# Altium schematic sheet klpflyv1.0.SchDoc: klpfly (continued)
## Library data of the parts (continued)
C22 = 100nF: Convert to PCB: yes; UniqueId: gged673bfa93339740f; OriginModelName: C0603_L1.6-W0.8-H0.8; ModelTransform: 62.992,31.496,0,0,0,0,0,0,0; Device: 100nF; Add into BOM: yes; SymbolName: 100nF; FootprintName: C0603
C23 = 100nF: Convert to PCB: yes; UniqueId: gge03e79812ca9f1594; OriginModelName: C0603_L1.6-W0.8-H0.8; ModelTransform: 62.992,31.496,0,0,0,0,0,0,0; Device: 100nF; Add into BOM: yes; SymbolName: 100nF; FootprintName: C0603
C24 = 2.2uF: Convert to PCB: yes; UniqueId: gge194ad5a5974422c7; OriginModelName: C0603_L1.6-W0.8-H0.8; ModelTransform: 62.992,31.496,0,0,0,0,0,0,0; Device: 2.2uF; Add into BOM: yes; SymbolName: 2.2uF; FootprintName: C0603
C25 = 100nF: Convert to PCB: yes; UniqueId: ggec38fa6919078953f; OriginModelName: C0603_L1.6-W0.8-H0.8; ModelTransform: 62.992,31.496,0,0,0,0,0,0,0; Device: 100nF; Add into BOM: yes; SymbolName: 100nF; FootprintName: C0603
C26 = 10uF: Convert to PCB: yes; UniqueId: ggeeb9301ced7e232ca; OriginModelName: C0603_L1.6-W0.8-H0.8; ModelTransform: 62.992,31.496,0,0,0,0,0,0,0; Device: 10uF; Add into BOM: yes; SymbolName: 10uF; FootprintName: C0603
C27 = 10uF: Convert to PCB: yes; UniqueId: gge9a113f5a677df9d8; OriginModelName: C0603_L1.6-W0.8-H0.8; ModelTransform: 62.992,31.496,0,0,0,0,0,0,0; Device: 10uF; Add into BOM: yes; SymbolName: 10uF; FootprintName: C0603
C28 = 100nF: Convert to PCB: yes; UniqueId: ggef40206292685441e; OriginModelName: C0603_L1.6-W0.8-H0.8; ModelTransform: 62.992,31.496,0,0,0,0,0,0,0; Device: 100nF; Add into BOM: yes; SymbolName: 100nF; FootprintName: C0603
C29 = 100nF: Convert to PCB: yes; UniqueId: gge2ebcfc57574d399a; OriginModelName: C0603_L1.6-W0.8-H0.8; ModelTransform: 62.992,31.496,0,0,0,0,0,0,0; Device: 100nF; Add into BOM: yes; SymbolName: 100nF; FootprintName: C0603
C30 = 100nF: Convert to PCB: yes; UniqueId: gged33014bcecda883b; OriginModelName: C0603_L1.6-W0.8-H0.8; ModelTransform: 62.992,31.496,0,0,0,0,0,0,0; Device: 100nF; Add into BOM: yes; SymbolName: 100nF; FootprintName: C0603
C31 = 100nF: Convert to PCB: yes; UniqueId: ggee2bd2f168eb7a19f; OriginModelName: C0603_L1.6-W0.8-H0.8; ModelTransform: 62.992,31.496,0,0,0,0,0,0,0; Device: 100nF; Add into BOM: yes; SymbolName: 100nF; FootprintName: C0603
C32 = 100nF: Convert to PCB: yes; UniqueId: ggedee51cfaf3930afd; OriginModelName: C0603_L1.6-W0.8-H0.8; ModelTransform: 62.992,31.496,0,0,0,0,0,0,0; Device: 100nF; Add into BOM: yes; SymbolName: 100nF; FootprintName: C0603
C33 = 100nF: Convert to PCB: yes; UniqueId: gge26811f5395af21ce; OriginModelName: C0603_L1.6-W0.8-H0.8; ModelTransform: 62.992,31.496,0,0,0,0,0,0,0; Device: 100nF; Add into BOM: yes; SymbolName: 100nF; FootprintName: C0603
C34 = 100nF: Convert to PCB: yes; UniqueId: gge8daa5e5140b19545; OriginModelName: C0603_L1.6-W0.8-H0.8; ModelTransform: 62.992,31.496,0,0,0,0,0,0,0; Device: 100nF; Add into BOM: yes; SymbolName: 100nF; FootprintName: C0603
C35 = 100nF: Convert to PCB: yes; UniqueId: gge108316898df37a9f; OriginModelName: C0603_L1.6-W0.8-H0.8; ModelTransform: 62.992,31.496,0,0,0,0,0,0,0; Device: 100nF; Add into BOM: yes; SymbolName: 100nF; FootprintName: C0603
C36 = 100nF: Convert to PCB: yes; UniqueId: gge1844c11426338be2; OriginModelName: C0603_L1.6-W0.8-H0.8; ModelTransform: 62.992,31.496,0,0,0,0,0,0,0; Device: 100nF; Add into BOM: yes; SymbolName: 100nF; FootprintName: C0603
C37 = 100nF: Convert to PCB: yes; UniqueId: ggefc1b89ea0528c883; OriginModelName: C0603_L1.6-W0.8-H0.8; ModelTransform: 62.992,31.496,0,0,0,0,0,0,0; Device: 100nF; Add into BOM: yes; SymbolName: 100nF; FootprintName: C0603
C38 = 100nF: Convert to PCB: yes; UniqueId: gge2b0adef4c2000f72; OriginModelName: C0603_L1.6-W0.8-H0.8; ModelTransform: 62.992,31.496,0,0,0,0,0,0,0; Device: 100nF; Add into BOM: yes; SymbolName: 100nF; FootprintName: C0603
C39 = 2.2uF: Convert to PCB: yes; UniqueId: gge6b0287d4c016d85a; OriginModelName: C0603_L1.6-W0.8-H0.8; ModelTransform: 62.992,31.496,0,0,0,0,0,0,0; Device: 2.2uF; Add into BOM: yes; SymbolName: 2.2uF; FootprintName: C0603
CN1 = ZX-SH1.0-6PWT: Manufacturer: Megastar(兆星); Convert to PCB: yes; UniqueId: ggecd9d3fcf4734ba22; ModelTransform: 329.1332,198.8185,0,0,0,0,0.002,-7.876,0; Device: ZX-SH1.0-6PWT; Supplier: LCSC; Supplier Part: C7430448; Manufacturer Part: ZX-SH1.0-6PWT; JLCPCB Part Class: Extended Part; link: https://so.szlcsc.com/global.html?k=C7430448&ref=editor; Add into BOM: yes; SymbolName: SH1.0X6P; FootprintName: CONN-SMD_6P-P1.00_MEGASTAR_ZX-SH1.0-6PWT; OriginModelName: CONN-SMD_6P-P1.00_MEGASTAR_ZX-SH1.0-6PWT
CN2 = HDGC1002WR-S-3P: Manufacturer: HDGC(华德共创); Convert to PCB: yes; UniqueId: gge2ce44b7eaad9832b; ModelTransform: 210.63,196.85,0,0,0,0,0,-9.565,0; Device: HDGC1002WR-S-3P; Supplier: LCSC; Supplier Part: C2936213; Manufacturer Part: HDGC1002WR-S-3P; JLCPCB Part Class: Extended Part; Add into BOM: yes; SymbolName: SH1.0-3P; FootprintName: CONN-SMD_3P-P1.00_HDGC_HDGC1002WR-S-3P; OriginModelName: CONN-SMD_3P-P1.00_HDGC_HDGC1002WR-S-3P
CN3 = WAFER_SMT_1.0X8: Manufacturer: null; Convert to PCB: yes; UniqueId: ggebe725300a9fc9f2b; ModelTransform: 407.873,198.8185,0,0,0,0,-0.001,-16.732,0; Device: WAFER_SMT_1.0X8; Supplier: LCSC; Supplier Part: C9900021939; Manufacturer Part: WAFER_SMT_1.0X8; JLCPCB Part Class: Extended Part; Add into BOM: yes; SymbolName: SH1.0X8P; FootprintName: CONN-SMD_8P-P1.00_WAFER-SH1.0-8PWB; OriginModelName: CONN-SMD_8P-P1.00_WAFER-SH1.0-8PWB
CN4 = HDGC1002WR-S-3P: Manufacturer: HDGC(华德共创); Convert to PCB: yes; UniqueId: ggec0020a35e89ad4ff; ModelTransform: 210.63,196.85,0,0,0,0,0,-9.565,0; Device: HDGC1002WR-S-3P; Supplier: LCSC; Supplier Part: C2936213; Manufacturer Part: HDGC1002WR-S-3P; JLCPCB Part Class: Extended Part; Add into BOM: yes; SymbolName: SH1.0-3P; FootprintName: CONN-SMD_3P-P1.00_HDGC_HDGC1002WR-S-3P; OriginModelName: CONN-SMD_3P-P1.00_HDGC_HDGC1002WR-S-3P
CN5 = HDGC1002WR-S-3P: Manufacturer: HDGC(华德共创); Convert to PCB: yes; UniqueId: gge5e0003f38aa131f5; ModelTransform: 210.63,196.85,0,0,0,0,0,-9.565,0; Device: HDGC1002WR-S-3P; Supplier: LCSC; Supplier Part: C2936213; Manufacturer Part: HDGC1002WR-S-3P; JLCPCB Part Class: Extended Part; Add into BOM: yes; SymbolName: SH1.0-3P; FootprintName: CONN-SMD_3P-P1.00_HDGC_HDGC1002WR-S-3P; OriginModelName: CONN-SMD_3P-P1.00_HDGC_HDGC1002WR-S-3P
CN6 = HDGC1002WR-S-3P: Manufacturer: HDGC(华德共创); Convert to PCB: yes; UniqueId: ggecca6adc977efc5d6; ModelTransform: 210.63,196.85,0,0,0,0,0,-9.565,0; Device: HDGC1002WR-S-3P; Supplier: LCSC; Supplier Part: C2936213; Manufacturer Part: HDGC1002WR-S-3P; JLCPCB Part Class: Extended Part; Add into BOM: yes; SymbolName: SH1.0-3P; FootprintName: CONN-SMD_3P-P1.00_HDGC_HDGC1002WR-S-3P; OriginModelName: CONN-SMD_3P-P1.00_HDGC_HDGC1002WR-S-3P
CN7 = ZX-SH1.0-6PWT: Manufacturer: Megastar(兆星); Convert to PCB: yes; UniqueId: gge7f46dd2bd5c42fec; ModelTransform: 329.1332,198.8185,0,0,0,0,0.002,-7.876,0; Device: ZX-SH1.0-6PWT; Supplier: LCSC; Supplier Part: C7430448; Manufacturer Part: ZX-SH1.0-6PWT; JLCPCB Part Class: Extended Part; link: https://so.szlcsc.com/global.html?k=C7430448&ref=editor; Add into BOM: yes; SymbolName: SH1.0X6P; FootprintName: CONN-SMD_6P-P1.00_MEGASTAR_ZX-SH1.0-6PWT; OriginModelName: CONN-SMD_6P-P1.00_MEGASTAR_ZX-SH1.0-6PWT
CN8 = HDGC1002WR-S-4P: Manufacturer: HDGC(华德共创); Convert to PCB: yes; UniqueId: ggee5a51ee7bd50bb1d; ModelTransform: 249.9995,196.85,0,0,0,0,0,-5.906,0; Device: HDGC1002WR-S-4P; Supplier: LCSC; Supplier Part: C2936214; Manufacturer Part: HDGC1002WR-S-4P; JLCPCB Part Class: Extended Part; Add into BOM: yes; SymbolName: HDGC1002WR-S-4P; FootprintName: CONN-SMD_4P-P1.00_HDGC_HDGC1002WR-S-4P; OriginModelName: CONN-SMD_4P-P1.00_HDGC_HDGC1002WR-S-4P
D1 = B5817WS-MS: Manufacturer: MSKSEMI(美森科); Convert to PCB: yes; UniqueId: gge7bf08ecfc7523faa; ModelTransform: 104.3305,51.181,0,0,0,0,0,0,0; Device: B5817WS-MS; Supplier: LCSC; Supplier Part: C2836388; Manufacturer Part: B5817WS-MS; JLCPCB Part Class: Extended Part; Add into BOM: yes; SymbolName: B5817WS-MS; FootprintName: SOD-323_L1.7-W1.3-LS2.7-FD; OriginModelName: SOD-323_L1.7-W1.3-LS2.7-FD
D2 = B5817WS-MS: Manufacturer: MSKSEMI(美森科); Convert to PCB: yes; UniqueId: gge33ebbc6fa40b7b0c; ModelTransform: 104.3305,51.181,0,0,0,0,0,0,0; Device: B5817WS-MS; Supplier: LCSC; Supplier Part: C2836388; Manufacturer Part: B5817WS-MS; JLCPCB Part Class: Extended Part; Add into BOM: yes; SymbolName: B5817WS-MS; FootprintName: SOD-323_L1.7-W1.3-LS2.7-FD; OriginModelName: SOD-323_L1.7-W1.3-LS2.7-FD
D3 = SMF28CA: Manufacturer: AnBon(安邦); Convert to PCB: yes; UniqueId: gge8336ca0810bb463b; ModelTransform: 145.669,70.866,0,0,0,0,0,0,0; Device: SMF28CA; Supplier: LCSC; Supplier Part: C435496; Manufacturer Part: SMF28CA; JLCPCB Part Class: Extended Part; link: https://so.szlcsc.com/global.html?k=C435496&ref=editor; Add into BOM: yes; SymbolName: SMF28CA; FootprintName: SOD-123_L2.7-W1.8-LS3.7-BI; OriginModelName: SOD-123_L2.7-W1.8-LS3.7-BI
H1 = HDR-F-2.54_1x4: Convert to PCB: no; UniqueId: gge885eefff489981f5; Device: HDR-F-2.54_1x4; Supplier Part: C225501; Supplier: LCSC; Add into BOM: no; Origin Footprint: HDR-F-2.54_1X4; SymbolName: HDR-F-2.54_1x4
H2 = HDR-F-2.54_1x4: Convert to PCB: no; UniqueId: ggeb2604217fb50aa1f; Device: HDR-F-2.54_1x4; Supplier Part: C225501; Supplier: LCSC; Add into BOM: no; Origin Footprint: HDR-F-2.54_1X4; SymbolName: HDR-F-2.54_1x4
H3 = HDR-F-2.54_1x4: Convert to PCB: no; UniqueId: ggee6be973db10bda17; Device: HDR-F-2.54_1x4; Supplier Part: C225501; Supplier: LCSC; Add into BOM: no; Origin Footprint: HDR-F-2.54_1X4; SymbolName: HDR-F-2.54_1x4
H6 = HDR-F-2.54_1x4: Convert to PCB: no; UniqueId: ggeb577fd7058a0a445; Device: HDR-F-2.54_1x4; Supplier Part: C225501; Supplier: LCSC; Add into BOM: no; Origin Footprint: HDR-F-2.54_1X4; SymbolName: HDR-F-2.54_1x4
H7 = HDR-F-2.54_1x3: Convert to PCB: no; UniqueId: ggeb90c589a3958aeec; Device: HDR-F-2.54_1x3; Supplier Part: C146690; Supplier: LCSC; Add into BOM: no; Origin Footprint: HDR-F-2.54_1X3; SymbolName: HDR-F-2.54_1x3
J1 = HDR-M-2.54_1x2: Convert to PCB: no; UniqueId: gge963c905d1ba80b10; Device: HDR-M-2.54_1x2; Supplier Part: C124375; Supplier: LCSC; Add into BOM: no; Origin Footprint: HDR-M-2.54_1X2; SymbolName: HDR-M-2.54_1x2
J2 = HDR-M-2.54_1x2: Convert to PCB: no; UniqueId: gge45273bc977e0dc7f; Device: HDR-M-2.54_1x2; Supplier Part: C124375; Supplier: LCSC; Add into BOM: no; Origin Footprint: HDR-M-2.54_1X2; SymbolName: HDR-M-2.54_1x2
J3 = HDR-M-2.54_1x2: Convert to PCB: no; UniqueId: gge86939b4fd004270e; Device: HDR-M-2.54_1x2; Supplier Part: C124375; Supplier: LCSC; Add into BOM: no; Origin Footprint: HDR-M-2.54_1X2; SymbolName: HDR-M-2.54_1x2
J4 = HDR-M-2.54_1x2: Convert to PCB: no; UniqueId: gge368a583462a7af64; Device: HDR-M-2.54_1x2; Supplier Part: C124375; Supplier: LCSC; Add into BOM: no; Origin Footprint: HDR-M-2.54_1X2; SymbolName: HDR-M-2.54_1x2
J5 = HDR-M-2.54_1x2: Convert to PCB: no; UniqueId: gge12fcbeb4db2ab241; Device: HDR-M-2.54_1x2; Supplier Part: C124375; Supplier: LCSC; Add into BOM: no; Origin Footprint: HDR-M-2.54_1X2; SymbolName: HDR-M-2.54_1x2
L1 = PHC0420-100M-T: Manufacturer: EMTEK; Convert to PCB: yes; UniqueId: gge99af4ca34bfde78c; OriginModelName: IND-SMD_L4.4-W4.0-H1.2_PHC0420; ModelTransform: 175.1965,159.842,0,0,0,0,0,0,0; Device: PHC0420-100M-T; Supplier: LCSC; Supplier Part: C251694; Manufacturer Part: PHC0420-100M-T; Add into BOM: yes; SymbolName: 10uH; FootprintName: IND-SMD_L4.4-W4.0_PHC0420
L2 = PHC0420-100M-T: Manufacturer: EMTEK; Convert to PCB: yes; UniqueId: gge7b26eb143931701e; OriginModelName: IND-SMD_L4.4-W4.0-H1.2_PHC0420; ModelTransform: 175.1965,159.842,0,0,0,0,0,0,0; Device: PHC0420-100M-T; Supplier: LCSC; Supplier Part: C251694; Manufacturer Part: PHC0420-100M-T; Add into BOM: yes; SymbolName: 10uH; FootprintName: IND-SMD_L4.4-W4.0_PHC0420
LED1 = 19-217/GHC-YR1S2/3T: Manufacturer: EVERLIGHT(台湾亿光); Convert to PCB: yes; UniqueId: ggec33a0d43bf0fd1a5; OriginModelName: LED0603-RD_GREEN; ModelTransform: 63.7794,31.496,0,0,0,0,0,0,0; Device: 19-217/GHC-YR1S2/3T; Manufacturer Part: 19-217/GHC-YR1S2/3T; Supplier Part: C72043; Supplier: LCSC; Add into BOM: yes; SymbolName: LED-0603_G; FootprintName: LED0603_GREEN
LED2 = 19-217/BHC-ZL1M2RY/3T: Manufacturer: EVERLIGHT(台湾亿光); Convert to PCB: yes; UniqueId: gge88f0d97242bbc373; ModelTransform: 63.07074,31.57474,0,180,0,0,0,0,0; Device: 19-217/BHC-ZL1M2RY/3T; Manufacturer Part: 19-217/BHC-ZL1M2RY/3T; Supplier Part: C72041; Supplier: LCSC; Add into BOM: yes; SymbolName: LED-0603_B; FootprintName: LED0603_BLUE; OriginModelName: LED0603_BLUE
Q1 = S8050LT1-J3Y: Manufacturer: FH(风华); Convert to PCB: yes; UniqueId: gge1c8eb3e3ebf663b6; OriginModelName: SOT-23-3P_L2.9-W1.3-H1.0-LS2.4-P0.95; ModelTransform: 98.64468,114.173,0,180,0,0,0.001,0.001,0; Device: S8050LT1-J3Y; Supplier: LCSC; Supplier Part: C2962087; Manufacturer Part: S8050LT1-J3Y; link: https://atta.szlcsc.com/upload/public/pdf/source/20220411/740B3F4857AB400E9826209E74F1EDA4.pdf; Add into BOM: yes; SymbolName: S8050LT1-J3Y; FootprintName: SOT-23_L2.9-W1.3-P1.90-LS2.4-BR
Q2 = S8050LT1-J3Y: Manufacturer: FH(风华); Convert to PCB: yes; UniqueId: gge7f16b287a280f568; OriginModelName: SOT-23-3P_L2.9-W1.3-H1.0-LS2.4-P0.95; ModelTransform: 98.64468,114.173,0,180,0,0,0.001,0.001,0; Device: S8050LT1-J3Y; Supplier: LCSC; Supplier Part: C2962087; Manufacturer Part: S8050LT1-J3Y; link: https://atta.szlcsc.com/upload/public/pdf/source/20220411/740B3F4857AB400E9826209E74F1EDA4.pdf; Add into BOM: yes; SymbolName: S8050LT1-J3Y; FootprintName: SOT-23_L2.9-W1.3-P1.90-LS2.4-BR
R1 = 20R: Convert to PCB: yes; UniqueId: gge2803cdfef027f426; ModelTransform: 31.8897,63.7794,0,90,0,0,0,0,0; Device: 20R; Add into BOM: yes; SymbolName: 20R; FootprintName: R0603; OriginModelName: R0603
R2 = 20R: Convert to PCB: yes; UniqueId: ggeae51583009f5c62d; ModelTransform: 31.8897,63.7794,0,90,0,0,0,0,0; Device: 20R; Add into BOM: yes; SymbolName: 20R; FootprintName: R0603; OriginModelName: R0603
R3 = 1M: Convert to PCB: yes; UniqueId: gge718708ee9e31e9c6; ModelTransform: 31.8897,63.7794,0,90,0,0,0,0,0; Device: 1M; Add into BOM: yes; SymbolName: 1M; FootprintName: R0603; OriginModelName: R0603
R4 = 1M: Convert to PCB: yes; UniqueId: ggee74e946aa43fe3b1; ModelTransform: 31.8897,63.7794,0,90,0,0,0,0,0; Device: 1M; Add into BOM: yes; SymbolName: 1M; FootprintName: R0603; OriginModelName: R0603
R5 = 22R: Convert to PCB: yes; UniqueId: gge1054e90f8c2270dd; ModelTransform: 31.8897,63.7794,0,90,0,0,0,0,0; Device: 22R; Add into BOM: yes; SymbolName: 22R; FootprintName: R0603; OriginModelName: R0603
R6 = 22R: Convert to PCB: yes; UniqueId: gge376c1236b153a772; ModelTransform: 31.8897,63.7794,0,90,0,0,0,0,0; Device: 22R; Add into BOM: yes; SymbolName: 22R; FootprintName: R0603; OriginModelName: R0603
R7 = 100k: Convert to PCB: yes; UniqueId: gge65a4b7670a104600; ModelTransform: 31.8897,63.7794,0,90,0,0,0,0,0; Device: 100k; Add into BOM: yes; SymbolName: 100k; FootprintName: R0603; OriginModelName: R0603
R8 = 51k: Convert to PCB: yes; UniqueId: gge9fd81eef2a8f7ffa; ModelTransform: 31.8897,63.7794,0,90,0,0,0,0,0; Device: 51k; Add into BOM: yes; SymbolName: 51k; FootprintName: R0603; OriginModelName: R0603
R9 = 41.2k: Convert to PCB: yes; UniqueId: gge9f85a8b729309dec; ModelTransform: 31.8897,63.7794,0,90,0,0,0,0,0; Device: 41.2k; Add into BOM: yes; SymbolName: 41.2k; FootprintName: R0603; OriginModelName: R0603
R10 = 100k: Convert to PCB: yes; UniqueId: gge19e236c747ebd94a; ModelTransform: 31.8897,63.7794,0,90,0,0,0,0,0; Device: 100k; Add into BOM: yes; SymbolName: 100k; FootprintName: R0603; OriginModelName: R0603
R11 = 51k: Convert to PCB: yes; UniqueId: gge0f1b7351eff14f5c; ModelTransform: 31.8897,63.7794,0,90,0,0,0,0,0; Device: 51k; Add into BOM: yes; SymbolName: 51k; FootprintName: R0603; OriginModelName: R0603
R12 = 41.2k: Convert to PCB: yes; UniqueId: ggeaf2d57fb3ee954de; ModelTransform: 31.8897,63.7794,0,90,0,0,0,0,0; Device: 41.2k; Add into BOM: yes; SymbolName: 41.2k; FootprintName: R0603; OriginModelName: R0603
R13 = 3.6k: Convert to PCB: yes; UniqueId: gge2804a892dc8b5d22; ModelTransform: 31.8897,63.7794,0,90,0,0,0,0,0; Device: 3.6k; Add into BOM: yes; SymbolName: 3.6k; FootprintName: R0603; OriginModelName: R0603
R14 = 7.68k: Convert to PCB: yes; UniqueId: gge438bc0fbe55c7c82; ModelTransform: 31.8897,63.7794,0,90,0,0,0,0,0; Device: 7.68k; Add into BOM: yes; SymbolName: 7.68k; FootprintName: R0603; OriginModelName: R0603
R15 = 10k: Convert to PCB: yes; UniqueId: ggeb37841dcc2a40db6; ModelTransform: 31.8897,63.7794,0,90,0,0,0,0,0; Device: 10k; Add into BOM: yes; SymbolName: 10k; FootprintName: R0603; OriginModelName: R0603
R16 = 1k: Convert to PCB: yes; UniqueId: gge14669116017803cb; ModelTransform: 31.8897,63.7794,0,90,0,0,0,0,0; Device: 1k; Add into BOM: yes; SymbolName: 1k; FootprintName: R0603; OriginModelName: R0603
R17 = 10k: Convert to PCB: yes; UniqueId: ggecda1f708b81c7ca6; ModelTransform: 31.8897,63.7794,0,90,0,0,0,0,0; Device: 10k; Add into BOM: yes; SymbolName: 10k; FootprintName: R0603; OriginModelName: R0603
R18 = 10k: Convert to PCB: yes; UniqueId: gge74c37a84cb754f85; ModelTransform: 31.8897,63.7794,0,90,0,0,0,0,0; Device: 10k; Add into BOM: yes; SymbolName: 10k; FootprintName: R0603; OriginModelName: R0603
R19 = 75R: Convert to PCB: yes; UniqueId: gge99ad03ce5fc1563c; ModelTransform: 31.8897,63.7794,0,90,0,0,0,0,0; Device: 75R; Add into BOM: yes; SymbolName: 75R; FootprintName: R0603; OriginModelName: R0603
R20 = 10k: Convert to PCB: yes; UniqueId: ggecccef22c02713413; ModelTransform: 31.8897,63.7794,0,90,0,0,0,0,0; Device: 10k; Add into BOM: yes; SymbolName: 10k; FootprintName: R0603; OriginModelName: R0603
R21 = 10k: Convert to PCB: yes; UniqueId: ggecb38663ade157f52; ModelTransform: 31.8897,63.7794,0,90,0,0,0,0,0; Device: 10k; Add into BOM: yes; SymbolName: 10k; FootprintName: R0603; OriginModelName: R0603
R22 = 75R: Convert to PCB: yes; UniqueId: gge175528db6f6a6a66; ModelTransform: 31.8897,63.7794,0,90,0,0,0,0,0; Device: 75R; Add into BOM: yes; SymbolName: 75R; FootprintName: R0603; OriginModelName: R0603
R23 = 10k: Convert to PCB: yes; UniqueId: ggee41f9b045fab3390; ModelTransform: 31.8897,63.7794,0,90,0,0,0,0,0; Device: 10k; Add into BOM: yes; SymbolName: 10k; FootprintName: R0603; OriginModelName: R0603
R24 = 4K7: Convert to PCB: yes; UniqueId: gge096ca4e081fb04e8; ModelTransform: 31.8897,63.7794,0,90,0,0,0,0,0; Device: 4K7; Add into BOM: yes; SymbolName: 4K7; FootprintName: R0603; OriginModelName: R0603
R25 = 4K7: Convert to PCB: yes; UniqueId: gge5e765753ece9e3c8; ModelTransform: 31.8897,63.7794,0,90,0,0,0,0,0; Device: 4K7; Add into BOM: yes; SymbolName: 4K7; FootprintName: R0603; OriginModelName: R0603
R26 = 1k: Convert to PCB: yes; UniqueId: ggee0760564004a1d0b; ModelTransform: 31.8897,63.7794,0,90,0,0,0,0,0; Device: 1k; Add into BOM: yes; SymbolName: 1k; FootprintName: R0603; OriginModelName: R0603
R27 = 1k: Convert to PCB: yes; UniqueId: ggebc1ed0bbe25fab2f; ModelTransform: 31.8897,63.7794,0,90,0,0,0,0,0; Device: 1k; Add into BOM: yes; SymbolName: 1k; FootprintName: R0603; OriginModelName: R0603
R28 = 1k: Convert to PCB: yes; UniqueId: ggee94924af568416b5; ModelTransform: 31.8897,63.7794,0,90,0,0,0,0,0; Device: 1k; Add into BOM: yes; SymbolName: 1k; FootprintName: R0603; OriginModelName: R0603
R29 = 4D02WGF1002TCE: Manufacturer: UNI-ROYAL(厚声); Convert to PCB: yes; UniqueId: gge07544b47d1892801; OriginModelName: R0402-8P_L2.0-W1.0-H0.5; ModelTransform: 78.74,39.37,0,180,0,0,0,0,0; Device: 4D02WGF1002TCE; Supplier: LCSC; Supplier Part: C414600; Manufacturer Part: 4D02WGF1002TCE; Add into BOM: yes; SymbolName: 100*4; FootprintName: RES-ARRAY-SMD_0402-8P-L2.0-W1.0-BL
R30 = 4D02WGF1002TCE: Manufacturer: UNI-ROYAL(厚声); Convert to PCB: yes; UniqueId: gge77dae21efa63f364; OriginModelName: R0402-8P_L2.0-W1.0-H0.5; ModelTransform: 78.74,39.37,0,180,0,0,0,0,0; Device: 4D02WGF1002TCE; Supplier: LCSC; Supplier Part: C414600; Manufacturer Part: 4D02WGF1002TCE; Add into BOM: yes; SymbolName: 100*4; FootprintName: RES-ARRAY-SMD_0402-8P-L2.0-W1.0-BL
R31 = 1k: Convert to PCB: yes; UniqueId: ggec1dfd3b01c2c65db; ModelTransform: 31.8897,63.7794,0,90,0,0,0,0,0; Device: 1k; Add into BOM: yes; SymbolName: 1k; FootprintName: R0603; OriginModelName: R0603
R32 = RC0402FR-0710KL: Manufacturer: YAGEO(国巨); Convert to PCB: yes; UniqueId: ggefd6f330f786ae1bc; OriginModelName: R0402_L1.0-W0.5-H0.4; ModelTransform: 39.37,19.685,0,0,0,0,0,0.001,0; Device: RC0402FR-0710KL; Supplier: LCSC; Manufacturer Part: RC0402FR-0710KL; Supplier Part: C60490; JLCPCB Part Class: Extended Part; Add into BOM: yes; SymbolName: 10kΩ; FootprintName: R0402
R33 = RC0402FR-0710KL: Manufacturer: YAGEO(国巨); Convert to PCB: yes; UniqueId: ggeb12758e104cafe18; OriginModelName: R0402_L1.0-W0.5-H0.4; ModelTransform: 39.37,19.685,0,0,0,0,0,0.001,0; Device: RC0402FR-0710KL; Supplier: LCSC; Manufacturer Part: RC0402FR-0710KL; Supplier Part: C60490; JLCPCB Part Class: Extended Part; Add into BOM: yes; SymbolName: 10kΩ; FootprintName: R0402
R34 = RC0402FR-0710KL: Manufacturer: YAGEO(国巨); Convert to PCB: yes; UniqueId: gge03b7dc052d3712c7; OriginModelName: R0402_L1.0-W0.5-H0.4; ModelTransform: 39.37,19.685,0,0,0,0,0,0.001,0; Device: RC0402FR-0710KL; Supplier: LCSC; Manufacturer Part: RC0402FR-0710KL; Supplier Part: C60490; JLCPCB Part Class: Extended Part; Add into BOM: yes; SymbolName: 10kΩ; FootprintName: R0402
R35 = RC0402FR-0710KL: Manufacturer: YAGEO(国巨); Convert to PCB: yes; UniqueId: gge0e8147650a4c1f88; OriginModelName: R0402_L1.0-W0.5-H0.4; ModelTransform: 39.37,19.685,0,0,0,0,0,0.001,0; Device: RC0402FR-0710KL; Supplier: LCSC; Manufacturer Part: RC0402FR-0710KL; Supplier Part: C60490; JLCPCB Part Class: Extended Part; Add into BOM: yes; SymbolName: 10kΩ; FootprintName: R0402
R36 = RC0402FR-0710KL: Manufacturer: YAGEO(国巨); Convert to PCB: yes; UniqueId: gge4607301ef64e3a36; OriginModelName: R0402_L1.0-W0.5-H0.4; ModelTransform: 39.37,19.685,0,0,0,0,0,0.001,0; Device: RC0402FR-0710KL; Supplier: LCSC; Manufacturer Part: RC0402FR-0710KL; Supplier Part: C60490; JLCPCB Part Class: Extended Part; Add into BOM: yes; SymbolName: 10kΩ; FootprintName: R0402
SDO1 = BMI270: Convert to PCB: yes; UniqueId: ggebe24d6cd85f7bebd; OriginModelName: LGA-14_L2.5-W3.0-H0.9-P0.50; ModelTransform: 118.11,98.425,0,0,0,0,0,0.001,0; Device: BMI270; Supplier: InvenSense; link: https://3cfeqx1hf82y3xcoull08ihx-wpengine.netdna-ssl.com/wp-content/uploads/2020/09/DS-000347-ICM-42688-P-v1.3.pdf; Add into BOM: yes; SymbolName: BMI270; FootprintName: LGA-14_L3.0-W2.5-P0.50-TL
SW1 = TS-1073B-A2B2-D4: Manufacturer: Yuandi(元迪); Convert to PCB: yes; UniqueId: gge673417370de76ff0; ModelTransform: 188.976,137.795,0,0,0,0,0.66,24.554,-15.748; Device: TS-1073B-A2B2-D4; Supplier: LCSC; Supplier Part: C492942; Manufacturer Part: TS-1073B-A2B2-D4; JLCPCB Part Class: Extended Part; link: https://so.szlcsc.com/global.html?k=C492942&ref=editor; Add into BOM: yes; SymbolName: TS-1073B-A2B2-D4; FootprintName: KEY-SMD_TS-1073B-A2B2-D4; OriginModelName: KEY-SMD_TS-1073B-A2B2-D4
U1 = SPX3819M5-L-3-3/TR: Manufacturer: MaxLinear(迈凌); Convert to PCB: yes; UniqueId: ggead5155cd06fa3072; OriginModelName: SOT-23-5_L2.9-W1.6-H1.1-LS2.8-P0.95; ModelTransform: 114.173,109.636,0,180,0,0,0,-0.001,0; Device: SPX3819M5-L-3-3/TR; Supplier: LCSC; Manufacturer Part: SPX3819M5-L-3-3/TR; Supplier Part: C9055; JLCPCB Part Class: Extended Part; Add into BOM: yes; SymbolName: SPX3819M5-L-3-3/TR; FootprintName: SOT-23-5_L3.0-W1.7-P0.95-LS2.8-BL
U2 = MP9943: Convert to PCB: yes; UniqueId: ggeb87cc7bca5c8949e; Device: MP9943; Add into BOM: yes; SymbolName: MP9943; FootprintName: QFN-8-3X3
U3 = MP9943: Convert to PCB: yes; UniqueId: gge5de058e1dcebc45f; Device: MP9943; Add into BOM: yes; SymbolName: MP9943; FootprintName: QFN-8-3X3
U4 = MPU-6500: Manufacturer: TDK InvenSense(应美盛); Convert to PCB: yes; UniqueId: gge6fb0faa0bb8ee760; OriginModelName: QFN-24_L3.0-W3.0-H0.9-P0.40-BL-EP; ModelTransform: 118.11,118.11,0,90,0,0,0,0,0; Device: MPU-6500; Supplier: LCSC; Manufacturer Part: MPU-6500; Supplier Part: C50278; JLCPCB Part Class: Extended Part; Add into BOM: yes; SymbolName: MPU6500; FootprintName: QFN-24_L3.0-W3.0-P0.40-BL-EP
U5 = 8M/3213: Convert to PCB: yes; UniqueId: ggee29a88e2d2ac9ac9; ModelTransform: 125.984,51.181,0,0,0,0,-0.592,-0.591,0; Device: 8M/3213; Add into BOM: yes; SymbolName: 8M/3213; FootprintName: X3213; OriginModelName: X3213
U6 = AT32F435VMT7: Manufacturer: ARTERY（雅特力）; Convert to PCB: yes; UniqueId: ggece277d5420079038; OriginModelName: LQFP-100_L14.0-W14.0-H1.4-LS16.0-P0.50; ModelTransform: 629.921,629.921,0,270,0,0,0,0,0; Device: AT32F435VMT7; Supplier: LCSC; Supplier Part: C3029578; Manufacturer Part: AT32F435VMT7; link: https://atta.szlcsc.com/upload/public/pdf/source/20220608/9A6D4578C11CEA8ECA586071DFEBC06A.pdf; Add into BOM: yes; SymbolName: AT32F437VMT7-LQFP100; FootprintName: LQFP-100_L14.0-W14.0-P0.50-LS16.0-TL
U7 = BMP280: Manufacturer: Bosch; Convert to PCB: yes; UniqueId: gge447de30e0e3d1cf2; OriginModelName: LGA-8_L2.0-W2.5-H1.0-P0.65; ModelTransform: 98.425,78.74,0,270,0,0,0.005,-0.001,0; Device: BMP280; Supplier: LCSC; Manufacturer Part: BMP280; Supplier Part: C83291; JLCPCB Part Class: Extended Part; Add into BOM: yes; SymbolName: BMP280; FootprintName: SENSOR-TH_BMP280-BL
U8 = 2016晶振/27M: Convert to PCB: yes; UniqueId: gge8a1c1357ed2894bc; OriginModelName: OSC-SMD_4P-L2.0-W1.6-H0.8; ModelTransform: 78.74,62.992,0,0,0,0,0,0,0; Device: 2016晶振/27M; Add into BOM: yes; SymbolName: 2016晶振/27M; FootprintName: 2016晶振
U9 = AT7456E: Manufacturer: ZHONGKEWEI; Convert to PCB: yes; UniqueId: gge0ef7d474198b7014; ModelTransform: 381.889,251.968,0,0,0,0,0,0.005,0; Device: AT7456E; Supplier: LCSC; Manufacturer Part: AT7456E; Supplier Part: C82351; JLCPCB Part Class: Extended Part; Add into BOM: yes; SymbolName: AT7456E; FootprintName: TSSOP-28_L9.7-W4.4-P0.65-LS6.4-BL-EP5.5; OriginModelName: TSSOP-28_L9.7-W4.4-P0.65-LS6.4-BL-EP5.5
U10 = W25N01GVZEIG: Manufacturer: Winbond Elec; Convert to PCB: yes; UniqueId: ggee63176ef5aab684c; OriginModelName: WSON-8_L8.0-W6.0-H0.8-P1.27; ModelTransform: 315.7474,236.22,0,0,0,0,0,0,0; Device: W25N01GVZEIG; Supplier: LCSC; Supplier Part: C88868; Manufacturer Part: W25N01GVZEIG; JLCPCB Part Class: Extended Part; Add into BOM: yes; SymbolName: W25N01GVZEIG; FootprintName: WSON-8_L8.0-W6.10-P1.27-EP
U11 = ZX-SH1.0-10PWT: Manufacturer: Megastar(兆星); Convert to PCB: yes; UniqueId: gge7200404e0632cc6f; ModelTransform: 486.613,198.8185,0,0,0,0,-0.001,-6.062,0; Device: ZX-SH1.0-10PWT; Supplier: LCSC; Supplier Part: C19272377; Manufacturer Part: ZX-SH1.0-10PWT; Add into BOM: yes; SymbolName: ZX-SH1.0-10PWT; FootprintName: CONN-SMD_10P-P1.00_ZX-SH1.0-10PWT; OriginModelName: CONN-SMD_10P-P1.00_ZX-SH1.0-10PWT
U12 = SPX3819M5-L-3-3/TR: Manufacturer: MaxLinear(迈凌); Convert to PCB: yes; UniqueId: gge70c12bce5ebcd7d5; OriginModelName: SOT-23-5_L2.9-W1.6-H1.1-LS2.8-P0.95; ModelTransform: 114.173,109.636,0,180,0,0,0,-0.001,0; Device: SPX3819M5-L-3-3/TR; Supplier: LCSC; Manufacturer Part: SPX3819M5-L-3-3/TR; Supplier Part: C9055; JLCPCB Part Class: Extended Part; Add into BOM: yes; SymbolName: SPX3819M5-L-3-3/TR; FootprintName: SOT-23-5_L3.0-W1.7-P0.95-LS2.8-BL
USB1 = TYPEC-304A-ACP16L: Manufacturer: XUNPU(讯普); Convert to PCB: yes; UniqueId: gge27292bd05ad1f100; ModelTransform: 351.9678,298.4246,0,180,0,0,0,-45.275,-39.37; Device: TYPEC-304A-ACP16L; Supplier: LCSC; Supplier Part: C2909609; Manufacturer Part: TYPEC-304A-ACP16L; JLCPCB Part Class: Extended Part; Add into BOM: yes; SymbolName: TYPEC-304A-16L; FootprintName: USB-C-SMD_XUNPU_TYPEC-304A-ACP16L; OriginModelName: USB-C-SMD_XUNPU_TYPEC-304A-ACP16L